# EasyEDA Pro project MushIO_V1p0_Final.eprj, schematic ADS124S08_ADC
Board Name: ADS124S08_ADC; Create Date: 2025-11-03; Page Name: ADC; Project Name: MushIO_V1p2; Schematic Name: ADS124S08_ADC; Update Date: 2025-11-23; Company: EasyEDA.com; Page Size: A4; Version: V1.0
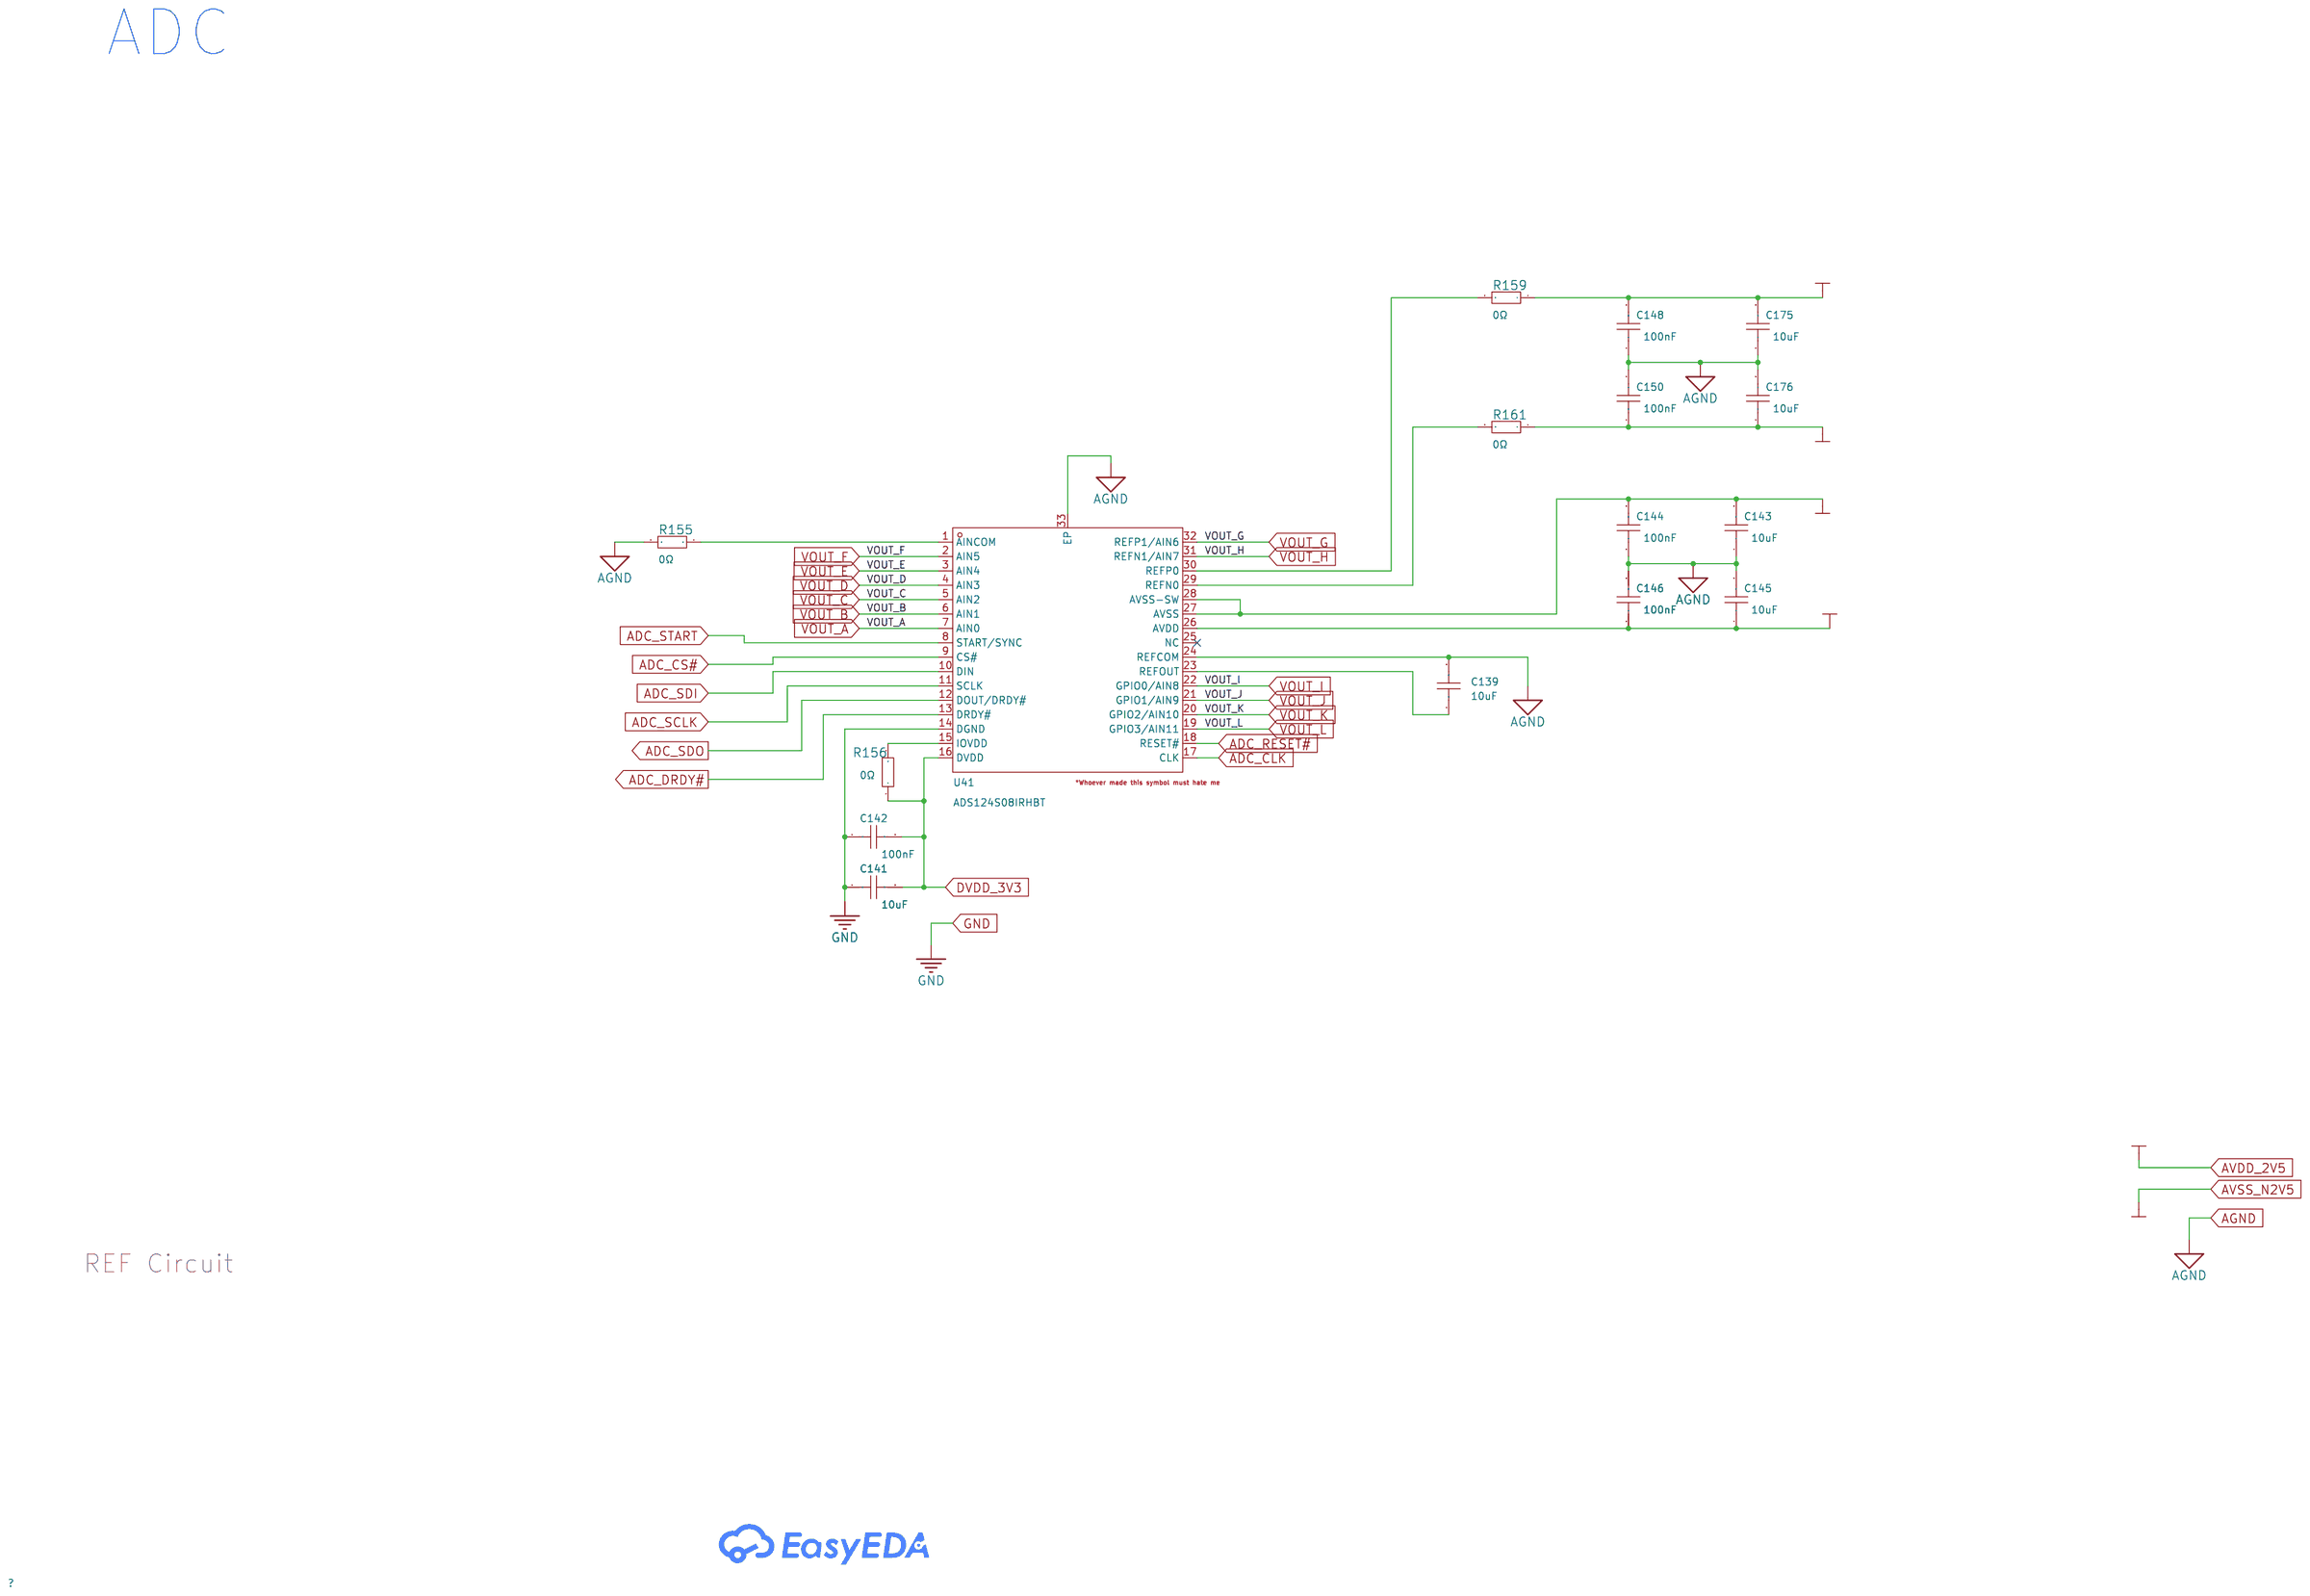
[diagram p1: schematic sheet]

## Parts
C139  10uF  [C0603]
C141  10uF  [C0603]
C142  100nF  [C0402]
C143  10uF  [C0603]
C144  100nF  [C0402]
C145  10uF  [C0603]
C146  100nF  [C0402]
C148  100nF  [C0402]
C150  100nF  [C0402]
C175  10uF  [C0603]
C176  10uF  [C0603]
R155  0Ω  [R0402]
R156  0Ω  [R0402]
R159  0Ω  [R0402]
R161  0Ω  [R0402]
U41  ADS124S08IRHBT  [VQFN-32_L5.0-W5.0-P0.50-TL-EP2.1]

## Library data of the parts
C139 C141 C143 C145 C175 C176 = CL10A106KP8NNNC: Capacitance: Tolerance:±10% Tolerance:±10% Voltage Rated: Temperature Coefficient:; LCSC Part Name: 10uF ±10% 10V; Supplier Part: C19702; Manufacturer: SAMSUNG(三星); Supplier Footprint: 0603; JLCPCB Part Class: Basic Part; Datasheet: https://atta.szlcsc.com/upload/public/pdf/source/20160218/1457707763339.pdf; Supplier: LCSC; Tolerance: ±10%; Check: true
C142 C144 C146 C148 C150 = CL05B104KO5NNNC: Capacitance: Tolerance:±10% Tolerance:±10% Voltage Rated: Temperature Coefficient:; LCSC Part Name: 100nF ±10% 16V; Supplier Part: C1525; Manufacturer: SAMSUNG(三星); Supplier Footprint: 0402; JLCPCB Part Class: Basic Part; Datasheet: https://atta.szlcsc.com/upload/public/pdf/source/20160218/1457707763339.pdf; Supplier: LCSC; Tolerance: ±10%; Check: true
R155 R156 R159 R161 = 0402WGF0000TCE: Type:Thick Film Resistors Resistance: Tolerance:±1% Tolerance:±1% Power(Watts): Overload Voltage (Max): Temperature Coefficient:±800ppm/℃ Temperature Coefficient:±800ppm/℃ Operating Temperature Range:-55℃~+155℃ Operating Temperature Range:-55℃~+155℃; LCSC Part Name: 0Ω ±1% 62.5mW 厚膜电阻; Supplier Part: C17168; Manufacturer: UNI-ROYAL(厚声); Supplier Footprint: 0402; JLCPCB Part Class: Basic Part; Datasheet: https://atta.szlcsc.com/upload/public/pdf/source/20200306/C422600_1E6D84923E4A46A82E41ADD87F860B5C.pdf; Supplier: LCSC; Type: Thick Film Resistors; Tolerance: ±1%; Temperature Coefficient: ±800ppm/℃; Operating Temperature Range: -55℃~+155℃; Check: true
U41 = ADS124S08IRHBT: Resolution(Bits):24 Sampling Rate:4kHz number of channels:12 Voltage - Supply:2.7V~5.25V Voltage - Supply:2.7V~5.25V Interface:SPI differential input:- Integral non - linearity:- Integral non - linearity:- Operating Temperature:-50℃~+125℃ Operating Temper; LCSC Part Name: 具有PGA和电压基准的低功耗、低噪声、高集成度6通道及12通道4kSPS、24位△-∑ADC; Supplier Part: C2655452; Manufacturer: TI(德州仪器); Supplier Footprint: VQFN-32-EP(5x5); JLCPCB Part Class: Extended Part; Datasheet: https://www.ti.com/cn/lit/gpn/ads124s06; Supplier: LCSC; Resolution(Bits): 24; Sampling Rate: 4kHz; number of channels: 12; Voltage - Supply: 2.7V~5.25V; Interface: SPI; Operating Temperature: -50℃~+125℃; Check: true

## Nets
AGND: C139.2 C143.1 C144.1 C145.2 C146.2 C148.1 C150.2 C175.1 C176.2 R155.2 U41.24(REFCOM) U41.33(EP)
AVDD_2V5: C145.1 C146.1 C148.2 C175.2 R159.1 U41.26(AVDD)
AVSS_N2V5: C143.2 C144.2 C150.1 C176.1 R161.1 U41.27(AVSS) U41.28(AVSS-SW)
DVDD_3V3: C141.2 C142.2 R156.1 U41.16(DVDD)
GND: C141.1 C142.1 U41.14(DGND)
ADC_CLK: U41.17(CLK)
ADC_CS#: U41.9(CS#)
ADC_DRDY#: U41.13(DRDY#)
ADC_RESET#: U41.18(RESET#)
ADC_SCLK: U41.11(SCLK)
ADC_SDI: U41.10(DIN)
ADC_SDO: U41.12(DOUT/DRDY#)
ADC_START: U41.8(START/SYNC)
VOUT_A: U41.7(AIN0)
VOUT_B: U41.6(AIN1)
VOUT_C: U41.5(AIN2)
VOUT_D: U41.4(AIN3)
VOUT_E: U41.3(AIN4)
VOUT_F: U41.2(AIN5)
VOUT_G: U41.32(REFP1/AIN6)
VOUT_H: U41.31(REFN1/AIN7)
VOUT_I: U41.22(GPIO0/AIN8)
VOUT_J: U41.21(GPIO1/AIN9)
VOUT_K: U41.20(GPIO2/AIN10)
VOUT_L: U41.19(GPIO3/AIN11)
$2N673: C139.1 U41.23(REFOUT)
$2N1227: R155.1 U41.1(AINCOM)
$2N1525: R156.2 U41.15(IOVDD)
$2N2371: R159.2 U41.30(REFP0)
$2N2417: R161.2 U41.29(REFN0)

Not connected (* = marked no-connect by the designer): U41 25(NC)*

## Notes on the sheet
- ADC
- *Whoever made this symbol must hate me
- REF Circuit
